# EasyEDA Pro project 智能视觉母版_2024.eprj, board PCB1
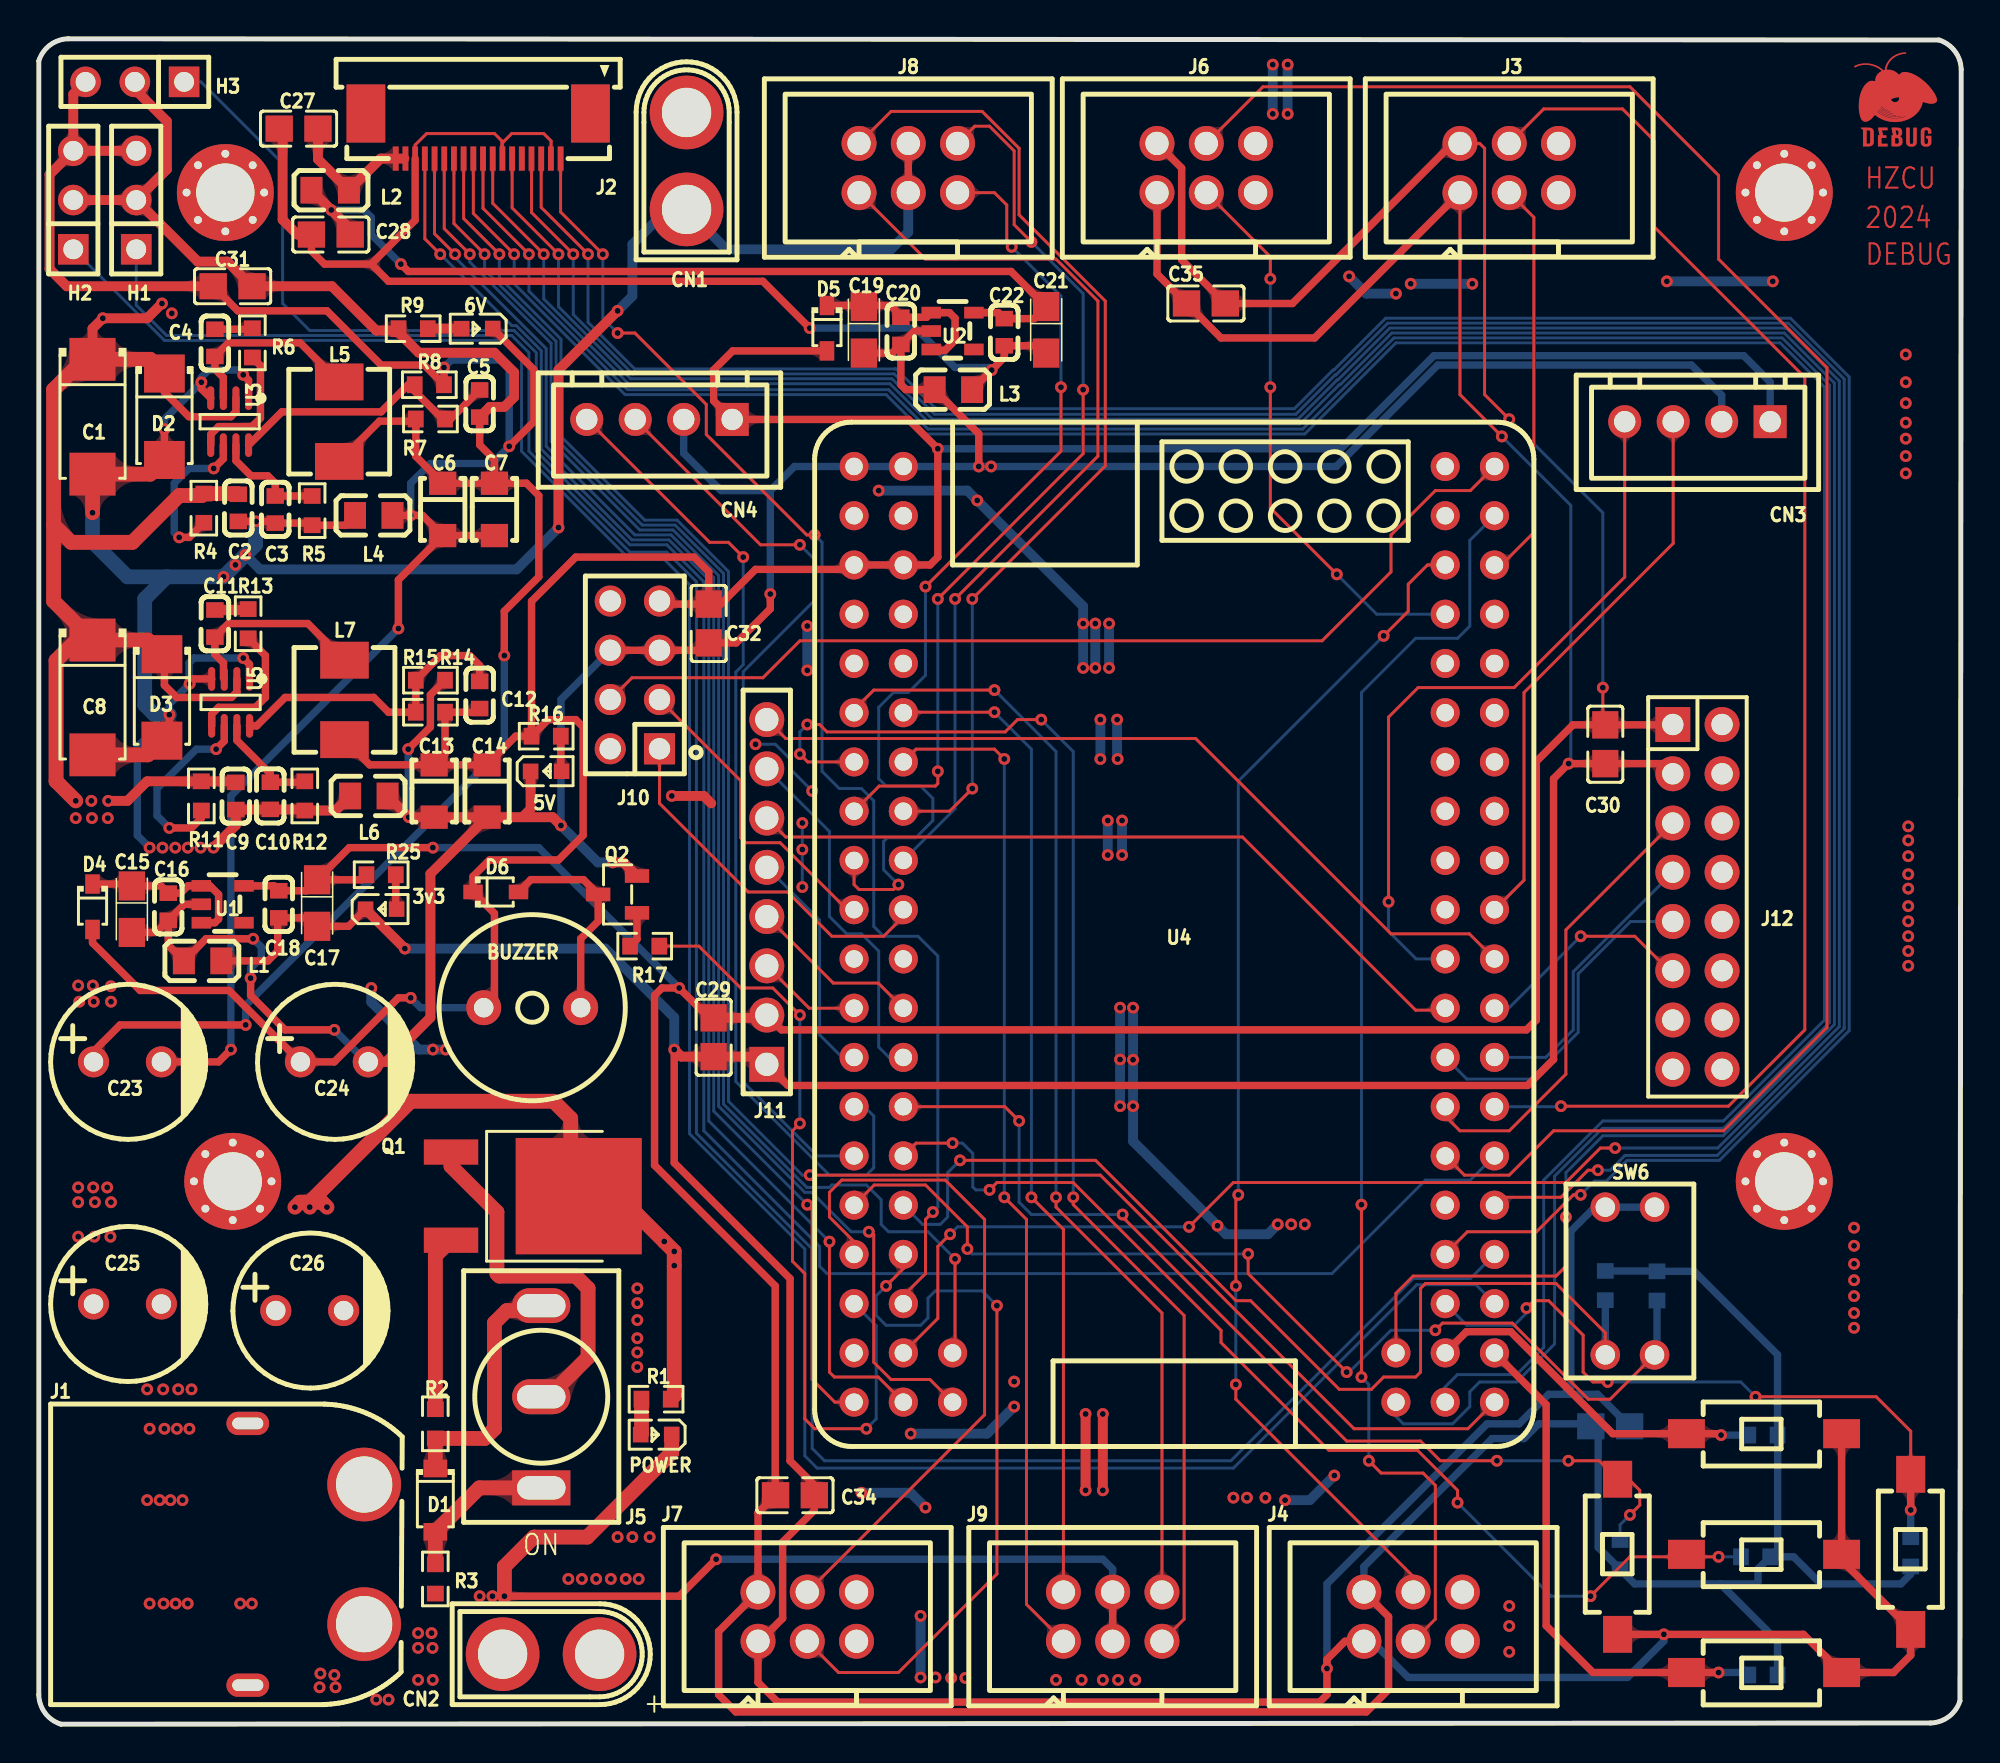
[diagram p1: board, top side]
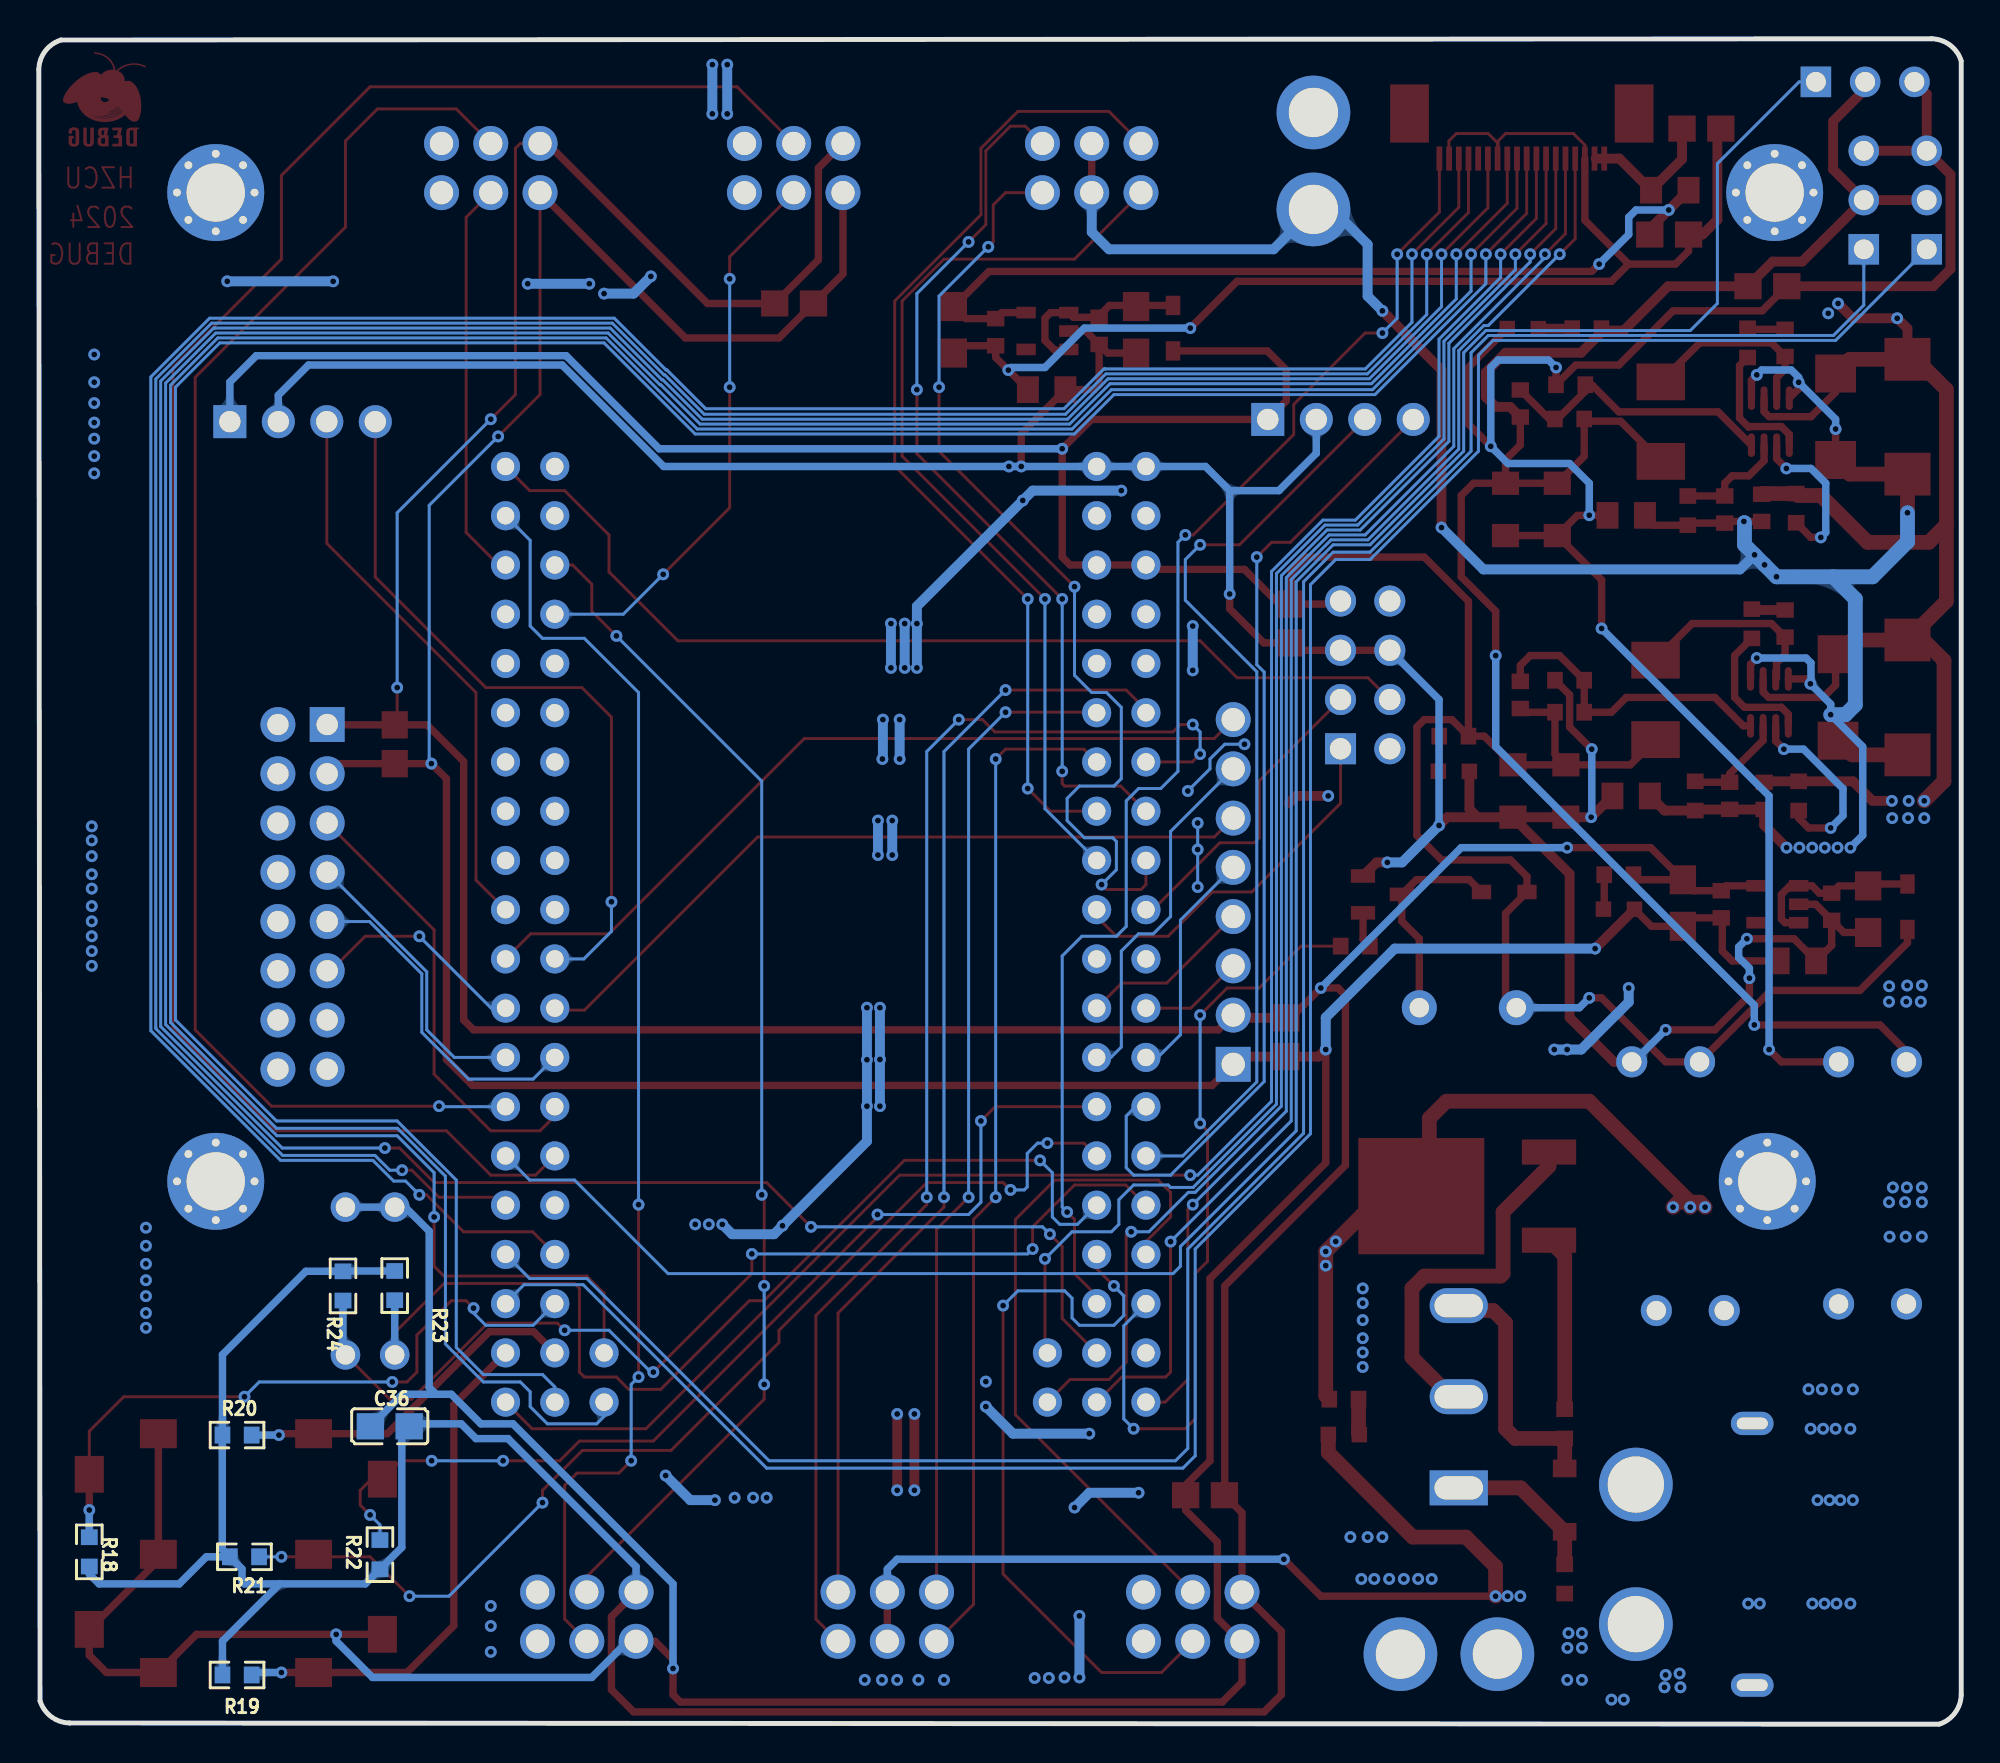
[diagram p2: board, bottom side, seen from below]

Outline 99.12 x 86.93 mm; copper layers: Top Layer, Bottom Layer. Coordinates in mm from the lower left corner of the outline.
Outline path: 0,85.79 arc(0.58,86.61) 1.52,86.93 97.98,86.87 arc(98.8,86.29) 99.12,85.34 99.06,1.21 arc(98.48,0.39) 97.54,0.06 1.14,0 arc(0.33,0.58) 0,1.52 0,85.79
Stack: Top Layer 0.035mm / Dielectric1 1.51mm FR4 er 4.5 / Bottom Layer 0.035mm

## Design rules (mm)
template: JLCPCB Capability(Two Layers Board)
spacing copperThickness1oz (default): track to track 0.102, other pairs 0.152 to 0.3
spacing copperThickness2oz: track to track 0.203, other pairs 0.152 to 0.3
track width copperThickness1oz (default): min 0.127, default 0.254, max 2.54
track width copperThickness2oz: min 0.203, default 0.254, max 2.54
differential pair differentialPair (default): width min 0.127, default 0.254, max 2.54; gap min 0.152, default 0.152
via viaSize (default): diameter min 0.5, default 0.61, max 10; hole min 0.3, default 0.305, max 6.3

## Placement (name value [footprint] x y rotation side)
3v3  NCD0603W1  [LED0603-RD]  17.65 42.04 0 top
5V  NCD0603B1  [LED0603-RD]  26.16 49.15 0 top
6V  NCD0603W1  [LED0603-RD]  22.61 71.98 180 top
B1  M3螺柱孔_JX  [M3]  10 28 0 top
B2  M3螺柱孔_JX  [M3]  9.62 79 0 top
B3  M3螺柱孔_JX  [M3]  90 79 0 top
B4  M3螺柱孔_JX  [M3]  90 28 0 top
BUZZER  3000Hz  [BUZ-TH_BD9.6-P5.00-D0.7-FD]  25.44 36.96 0 top
C1  22uF  [CAP-SMD_L6.0-W3.2-R-RD]  2.77 67.44 90 top
C2  100nF  [C0603]  10.29 62.74 90 top
C3  100nF  [C0603]  12.19 62.65 270 top
C4  100nF  [C0603]  9.08 71.25 90 top
C5  33pF  [C0603]  22.73 68.12 90 top
C6  22uF  [CAP-SMD_L3.2-W1.6]  20.83 62.66 270 top
C7  22uF  [CAP-SMD_L3.2-W1.6]  23.5 62.66 270 top
C8  22uF  [CAP-SMD_L6.0-W3.2-R-RD]  2.77 52.96 90 top
C9  100nF  [C0603]  10.16 47.88 90 top
C10  100nF  [C0603]  11.94 47.89 90 top
C11  100nF  [C0603]  9.08 56.77 90 top
C12  33pF  [C0603]  22.73 53.09 90 top
C13  22uF  [CAP-SMD_L3.2-W1.6]  20.38 48.13 270 top
C14  22uF  [CAP-SMD_L3.2-W1.6]  23.11 48.13 270 top
C15  10uF  [CASE-A_3216]  4.8 42.04 270 top
C16  100nF  [C0603]  6.68 42.16 90 top
C17  10uF  [CASE-A_3216]  14.35 42.35 270 top
C18  100nF  [C0603]  12.37 42.29 90 top
C19  10uF  [CASE-A_3216]  42.54 71.92 270 top
C20  100nF  [C0603]  44.45 71.87 90 top
C21  10uF  [CASE-A_3216]  51.94 71.92 270 top
C22  100nF  [C0603]  49.78 71.8 90 top
C23  100uF  [CAP-TH_BD8.0-P3.50-D0.6-FD]  4.57 34.16 0 top
C24  100uF  [CAP-TH_BD8.0-P3.50-D0.6-FD]  15.24 34.16 0 top
C25  100uF  [CAP-TH_BD8.0-P3.50-D0.6-FD]  4.57 21.67 0 top
C26  100uF  [CAP-TH_BD8.0-P3.50-D0.6-FD]  13.97 21.34 0 top
C27  10uF  [C0805]  13.39 82.3 0 top
C28  10uF  [C0805]  15.06 76.83 0 top
C29  10uF  [C0805]  34.8 35.43 90 top
C30  10uF  [C0805]  80.77 50.55 90 top
C31  10uF  [C0805]  9.99 74.17 0 top
C32  10uF  [C0805]  34.54 56.77 90 top
C34  10uF  [C0805]  38.99 11.81 180 top
C35  10uF  [C0805]  60.18 73.28 0 top
C36  10uF  [C0805]  81.03 15.37 180 bottom
CN1  XT30U-M  [CONN-TH_XT30U-M]  33.4 80.63 90 top
CN2  XT30U-M  [CONN-TH_XT30U-M]  26.42 3.61 0 top
CN3  HC-XH-4A-G  [CONN-TH_4P-P2.50_HC-XH-4A-G]  85.52 67.18 180 top
CN4  HC-XH-4A-G  [CONN-TH_4P-P2.50_HC-XH-4A-G]  32 67.3 180 top
D1  BZT52C16  [SOD-123_L2.7-W1.6-LS3.7-RD]  20.45 11.56 270 top
D2  SMAJ12A  [SMA_L4.4-W2.7-LS5.1-RD]  6.48 67.44 270 top
D3  SMAJ12A  [SMA_L4.4-W2.7-LS5.1-RD]  6.35 52.96 270 top
D4  1N5819WS  [SOD-323_L1.8-W1.3-LS2.5-RD]  2.77 42.16 270 top
D5  1N5819WS  [SOD-323_L1.8-W1.3-LS2.5-RD]  40.64 72.01 270 top
D6  1N5819WS  [SOD-323_L1.8-W1.3-LS2.5-RD]  23.56 42.93 0 top
H1  -  [HDR-TH_3P-P2.54-V-F]  5.02 78.61 90 top
H2  -  [HDR-TH_3P-P2.54-V-F]  1.78 78.61 90 top
H3  -  [HDR-TH_3P-P2.54-V-F]  4.95 84.71 180 top
J1  XT60PW-M  [CONN-TH_XT60PW-M]  13.78 8.76 0 top
J2  0.5K-AX-18PWBG  [FPC-SMD_18P-P0.50_HDGC_0.5K-AX-18PWBG]  22.66 81.92 180 top
J3  75869-131LF  [CONN-TH_6P-P2.54_75869-131LF]  75.82 80.26 0 top
J4  75869-131LF  [CONN-TH_6P-P2.54_75869-131LF]  70.87 5.55 0 top
J5  MT-0-102-A101-M200-RS  [SW-TH_MT-0-103-A101-M200-RS]  25.91 16.89 90 top
J6  75869-131LF  [CONN-TH_6P-P2.54_75869-131LF]  60.2 80.26 0 top
J7  75869-131LF  [CONN-TH_6P-P2.54_75869-131LF]  39.62 5.55 0 top
J8  75869-131LF  [CONN-TH_6P-P2.54_75869-131LF]  44.83 80.26 0 top
J9  75869-131LF  [CONN-TH_6P-P2.54_75869-131LF]  55.37 5.55 0 top
J10  -  [HDR-TH_8P-P2.54-V-F-R2-C4-S2.54-1]  30.73 54.12 90 top
J11  -  [HDR-TH_8P-P2.54-V-F-1]  37.54 42.93 90 top
J12  -  [HDR-TH_16P-P2.54-V-F-R2-C8-S2.54-1]  85.52 42.67 270 top
L1  CBG201209U000T  [L0805]  8.45 39.37 0 top
L2  CBG201209U000T  [L0805]  15.03 79.12 180 top
L3  CBG201209U000T  [L0805]  47.16 68.83 0 top
L4  CBG201209U000T  [L0805]  17.27 62.35 0 top
L5  4.7uH  [IND-SMD_L5.4-W5.2_FXL0530]  15.49 67.18 270 top
L6  CBG201209U000T  [L0805]  17.02 47.88 0 top
L7  4.7uH  [IND-SMD_L5.4-W5.2_FXL0530]  15.76 52.83 270 top
POWER  NCD0603R1  [LED0603-RD_RED]  31.83 14.94 180 top
Q1  NCE60P50K  [to-252-2_l6.6-w6.1-p4.57-ls9.9-tl-cw]  24.55 27.24 0 top
Q2  SS8050  [SOT-23-3_L2.9-W1.3-P1.90-LS2.4-BR]  29.84 42.8 0 top
R1  10kΩ  [R0603]  31.83 16.76 180 top
R2  4.7kΩ  [R0603]  20.45 15.49 90 top
R3  10kΩ  [R0603]  20.45 7.49 270 top
R4  100kΩ  [R0603]  8.51 62.72 90 top
R5  100kΩ  [R0603]  14.1 62.59 90 top
R6  10Ω  [R0603]  11.01 71.25 90 top
R7  38.3k  [R0603]  20.19 67.32 0 top
R8  4.3k  [R0603]  20.14 69.09 180 top
R9  10kΩ  [R0603]  19.3 71.98 0 top
R11  100kΩ  [R0603]  8.38 47.88 90 top
R12  100kΩ  [R0603]  13.72 47.88 90 top
R13  10Ω  [R0603]  10.8 56.76 90 top
R14  40.2k  [R0603]  20.19 52.2 180 top
R15  5.49k  [R0603]  20.19 53.85 180 top
R16  10kΩ  [R0603]  26.16 50.96 0 top
R17  1kΩ  [R0603]  31.24 40.13 180 top
R18  4.7K  [R0603]  96.52 8.89 270 bottom
R19  4.7K  [R0603]  88.9 2.54 0 bottom
R20  4.7K  [R0603]  88.9 14.91 0 bottom
R21  4.7K  [R0603]  88.52 8.64 0 bottom
R22  4.7K  [R0603]  81.53 8.75 270 bottom
R23  4.7K  [R0603]  80.77 22.62 90 bottom
R24  4.7K  [R0603]  83.44 22.61 90 bottom
R25  10kΩ  [R0603]  17.65 43.81 0 top
SW1  TS-1101-C-W  [SW-SMD_L6.0-W3.3-LS8.0]  96.52 8.89 270 top
SW2  TS-1101-C-W  [SW-SMD_L6.0-W3.3-LS8.0]  88.96 2.67 0 top
SW3  TS-1101-C-W  [SW-SMD_L6.0-W3.3-LS8.0]  88.96 14.99 0 top
SW4  TS-1101-C-W  [SW-SMD_L6.0-W3.3-LS8.0]  88.96 8.76 0 top
SW5  TS-1101-C-W  [SW-SMD_L6.0-W3.3-LS8.0]  81.41 8.64 270 top
SW6  KF1001-02P-R0-FL-ON-01B  [SW-TH_KF1001-02P-R0-FL-ON-01B]  82.04 22.86 0 top
U1  RT9013  [SOT-23-5_L2.9-W1.6-P0.95-LS2.8-BR]  9.48 42.29 180 top
U2  RT9013  [SOT-23-5_L2.9-W1.6-P0.95-LS2.8-BR]  47.12 71.86 180 top
U3  -  [tsot-23-8_l2.9-w1.6-p0.65-ls2.8-br]  9.84 67.18 90 top
U4  MIMXRT1064xVL_CoreBoard  [MIMXRT1064xVL_CoreBoard - 3D]  58.55 40.74 270 top
U5  -  [tsot-23-8_l2.9-w1.6-p0.65-ls2.8-br]  9.89 52.7 90 top

## Footprints (pads in the part's own frame, mm; a bottom-side part is the same pattern mirrored in y, then rotated)
BUZ-TH_BD9.6-P5.00-D0.7-FD
  round 1.8 hole 1: 1(-2.5,0) 2(2.5,0)
C0603
  rect 0.8x0.9 smd: 1(-0.7,0) 2(0.7,0)
C0805
  rect 1.41x1.35 smd: 1(-1,0) 2(1,0)
CAP-SMD_L3.2-W1.6
  rect 1.2x1.4 smd: 1(-1.35,0) 2(1.35,0)
CAP-SMD_L6.0-W3.2-R-RD
  rect 2.208x2.376 smd: 1(2.961,0) 2(-2.961,0)
CAP-TH_BD8.0-P3.50-D0.6-FD
  round 1.6 hole 1: 1(-1.75,0) 2(1.75,0)
CASE-A_3216
  rect 1.5x1.359 smd: 1(-1.2,0) 2(1.2,0)
CONN-TH_4P-P2.50_HC-XH-4A-G
  rect 1.7x1.7 hole 1.1: 1(-3.75,0)
  round 1.7 hole 1.1: 2(-1.25,0) 3(1.25,0) 4(3.75,0)
CONN-TH_6P-P2.54_75869-131LF
  round 1.8 hole 1.2: 1(-2.54,-1.27) 2(-2.54,1.27) 3(0,-1.27) 4(0,1.27) 5(2.54,-1.27) 6(2.54,1.27)
CONN-TH_XT30U-M
  round 3.8 hole 2.54: 1(-2.5,0) 2(2.5,0)
CONN-TH_XT60PW-M
  round 3.8 hole 2.9: 1(3,-3.6) 2(3,3.6)
  oval 2.2x1.2 hole 1.6x0.6: 3(-3,6.75) 4(-3,-6.75)
FPC-SMD_18P-P0.50_HDGC_0.5K-AX-18PWBG
  rect 0.3x1.25 smd: 1(-4.25,1.163) 2(-3.75,1.163) 3(-3.25,1.163) 4(-2.75,1.163) 5(-2.25,1.163) 6(-1.75,1.163) 7(-1.25,1.163) 8(-0.75,1.163) 9(-0.25,1.163) 10(0.25,1.163) 11(0.75,1.163) 12(1.25,1.163) 13(1.75,1.163) 14(2.25,1.163) 15(2.75,1.163) 16(3.25,1.163) 17(3.75,1.163) 18(4.25,1.163)
  rect 2x3 smd: 19(5.79,-1.163) 20(-5.79,-1.163)
HDR-TH_3P-P2.54-V-F
  rect 1.575x1.575 hole 1.02: 1(-2.54,0)
  round 1.575 hole 1.02: 2(0,0) 3(2.54,0)
HDR-TH_8P-P2.54-V-F-1
  rect 1.8x1.8 hole 1.2: 1(-8.89,0)
  round 1.8 hole 1.2: 2(-6.35,0) 3(-3.81,0) 4(-1.27,0) 5(1.27,0) 6(3.81,0) 7(6.35,0) 8(8.89,0)
HDR-TH_8P-P2.54-V-F-R2-C4-S2.54-1
  rect 1.6x1.6 hole 1.1: 1(-3.81,-1.27)
  round 1.6 hole 1.1: 2(-3.81,1.27) 3(-1.27,-1.27) 4(-1.27,1.27) 5(1.27,-1.27) 6(1.27,1.27) 7(3.81,-1.27) 8(3.81,1.27)
HDR-TH_16P-P2.54-V-F-R2-C8-S2.54-1
  rect 1.8x1.8 hole 1.1: 1(-8.89,-1.27)
  round 1.8 hole 1.1: 2(-8.89,1.27) 3(-6.35,-1.27) 4(-6.35,1.27) 5(-3.81,-1.27) 6(-3.81,1.27) 7(-1.27,-1.27) 8(-1.27,1.27) 9(1.27,-1.27) 10(1.27,1.27) 11(3.81,-1.27) 12(3.81,1.27) 13(6.35,-1.27) 14(6.35,1.27) 15(8.89,-1.27) 16(8.89,1.27)
IND-SMD_L5.4-W5.2_FXL0530
  rect 1.9x2.5 smd: 1(-2.05,0) 2(2.05,0)
L0805
  rect 1.133x1.377 smd: 1(-0.966,0) 2(0.966,0)
LED0603-RD
  rect 0.8x0.8 smd: 1(-0.799,-0.004) 2(0.799,0.004)
LED0603-RD_RED
  rect 0.8x0.8 smd: 1(-0.799,-0.004) 2(0.799,0.004)
M3
  round 0.6 hole 0.405x0.4: 1(-2,0) 1(-1.41,1.409) 1(-1.41,-1.41) 1(0,2) 1(0,-2) 1(1.41,1.409) 1(1.41,-1.41) 1(2,0)
  round 5 hole 3.005x3: 1(0,0)
MIMXRT1064xVL_CoreBoard - 3D
  round 1.5 hole 0.9: 1(-24.13,-16.51) 2(-24.13,-13.97) 3(-21.59,-16.51) 4(-21.59,-13.97) 5(-19.05,-16.51) 6(-19.05,-13.97) 7(-16.51,-16.51) 8(-16.51,-13.97) 9(-13.97,-16.51) 10(-13.97,-13.97) 11(-11.43,-16.51) 12(-11.43,-13.97) 13(-8.89,-16.51) 14(-8.89,-13.97) 15(-6.35,-16.51) 16(-6.35,-13.97) 17(-3.81,-16.51) 18(-3.81,-13.97) 19(-1.27,-16.51) 20(-1.27,-13.97) 21(1.27,-16.51) 22(1.27,-13.97) 23(3.81,-16.51) 24(3.81,-13.97) 25(6.35,-16.51) 26(6.35,-13.97) 27(8.89,-16.51) 28(8.89,-13.97) 29(11.43,-16.51) 30(11.43,-13.97) 31(13.97,-16.51) 32(13.97,-13.97) 33(16.51,-16.51) 34(16.51,-13.97) 35(19.05,-16.51) 36(19.05,-13.97) 37(21.59,-16.51) 38(21.59,-13.97) 39(24.13,-16.51) 40(24.13,-13.97) 41(21.59,-11.43) 42(24.13,-11.43) 43(24.13,11.43) 44(21.59,11.43) 45(24.13,13.97) 46(24.13,16.51) 47(21.59,13.97) 48(21.59,16.51) 49(19.05,13.97) 50(19.05,16.51) 51(16.51,13.97) 52(16.51,16.51) 53(13.97,13.97) 54(13.97,16.51) 55(11.43,13.97) 56(11.43,16.51) 57(8.89,13.97) 58(8.89,16.51) 59(6.35,13.97) 60(6.35,16.51) 61(3.81,13.97) 62(3.81,16.51) 63(1.27,13.97) 64(1.27,16.51) 65(-1.27,13.97) 66(-1.27,16.51) 67(-3.81,13.97) 68(-3.81,16.51) 69(-6.35,13.97) 70(-6.35,16.51) 71(-8.89,13.97) 72(-8.89,16.51) 73(-11.43,13.97) 74(-11.43,16.51) 75(-13.97,13.97) 76(-13.97,16.51) 77(-16.51,13.97) 78(-16.51,16.51) 79(-19.05,13.97) 80(-19.05,16.51) 81(-21.59,13.97) 82(-21.59,16.51) 83(-24.13,13.97) 84(-24.13,16.51)
R0603
  rect 0.806x0.864 smd: 1(-0.753,0) 2(0.753,0)
SMA_L4.4-W2.7-LS5.1-RD
  rect 1.96x2.1 smd: 1(-2.23,0) 2(2.23,0)
SOD-123_L2.7-W1.6-LS3.7-RD
  rect 0.91x1.22 smd: 1(-1.635,0) 2(1.635,0)
SOD-323_L1.8-W1.3-LS2.5-RD
  rect 1x0.75 smd: 1(-1.173,0) 2(1.173,0)
SOT-23-3_L2.9-W1.3-P1.90-LS2.4-BR
  rect 1.25x0.7 smd: 1(1,-0.95) 2(1,0.95) 3(-1,0)
SOT-23-5_L2.9-W1.6-P0.95-LS2.8-BR
  rect 1.001x0.6 smd: 1(1.1,-0.95) 2(1.1,0) 3(1.1,0.95) 4(-1.1,0.95) 5(-1.1,-0.95)
SW-SMD_L6.0-W3.3-LS8.0
  rect 1.9x1.5 smd: 1(-4,0) 2(4,0)
SW-TH_KF1001-02P-R0-FL-ON-01B
  round 1.524 hole 1: 1(-1.27,-3.81) 2(1.27,-3.81) 3(1.27,3.81) 4(-1.27,3.81)
SW-TH_MT-0-103-A101-M200-RS
  rect 1.8x3 hole 1.2x2.5: 1(-4.7,0)
  oval 1.8x3 hole 1.2x2.5: 2(0,0) 3(4.7,0)
to-252-2_l6.6-w6.1-p4.57-ls9.9-tl-cw
  rect 2.8x1.3 smd: 1(-3.292,2.273) 3(-3.292,-2.273)
  rect 6.5x6 smd: 2(3.292,0)
tsot-23-8_l2.9-w1.6-p0.65-ls2.8-br
  oval 1.222x0.364 smd: 1(1.211,-0.975) 2(1.211,-0.325) 3(1.211,0.325) 4(1.211,0.975) 5(-1.211,0.975) 6(-1.211,0.325) 7(-1.211,-0.325) 8(-1.211,-0.975)

## Nets
As in the schematic.

Pads without a net: B1 1; B2 1; B3 1; B4 1; J1 3 4; J2 5 19 20; J3 5 6; J4 5 6; J6 5 6; J7 5 6; J10 2 8; J12 2 4 6 8 10 12 13 14 15 16; U1 4; U2 4; U4 3 4 7 8 9 10 21 22 37 53 65 67 68 69 70 71 72 73 74 75 76 78 81 83

## Via types
v1: diameter 0.61, hole 0.305, Top Layer to Bottom Layer, 321 vias
